# EasyEDA Pro project sle_keyboard.eprj, schematic Schematic1

## Sheets
1 P1: Create Date: 2024-07-11; Page Name: P1; Project Name: sle_keyboard; Schematic Name: Schematic1; Update Date: 2024-08-14; Company: 嘉立创EDA; Page Size: A4; Version: V1.0
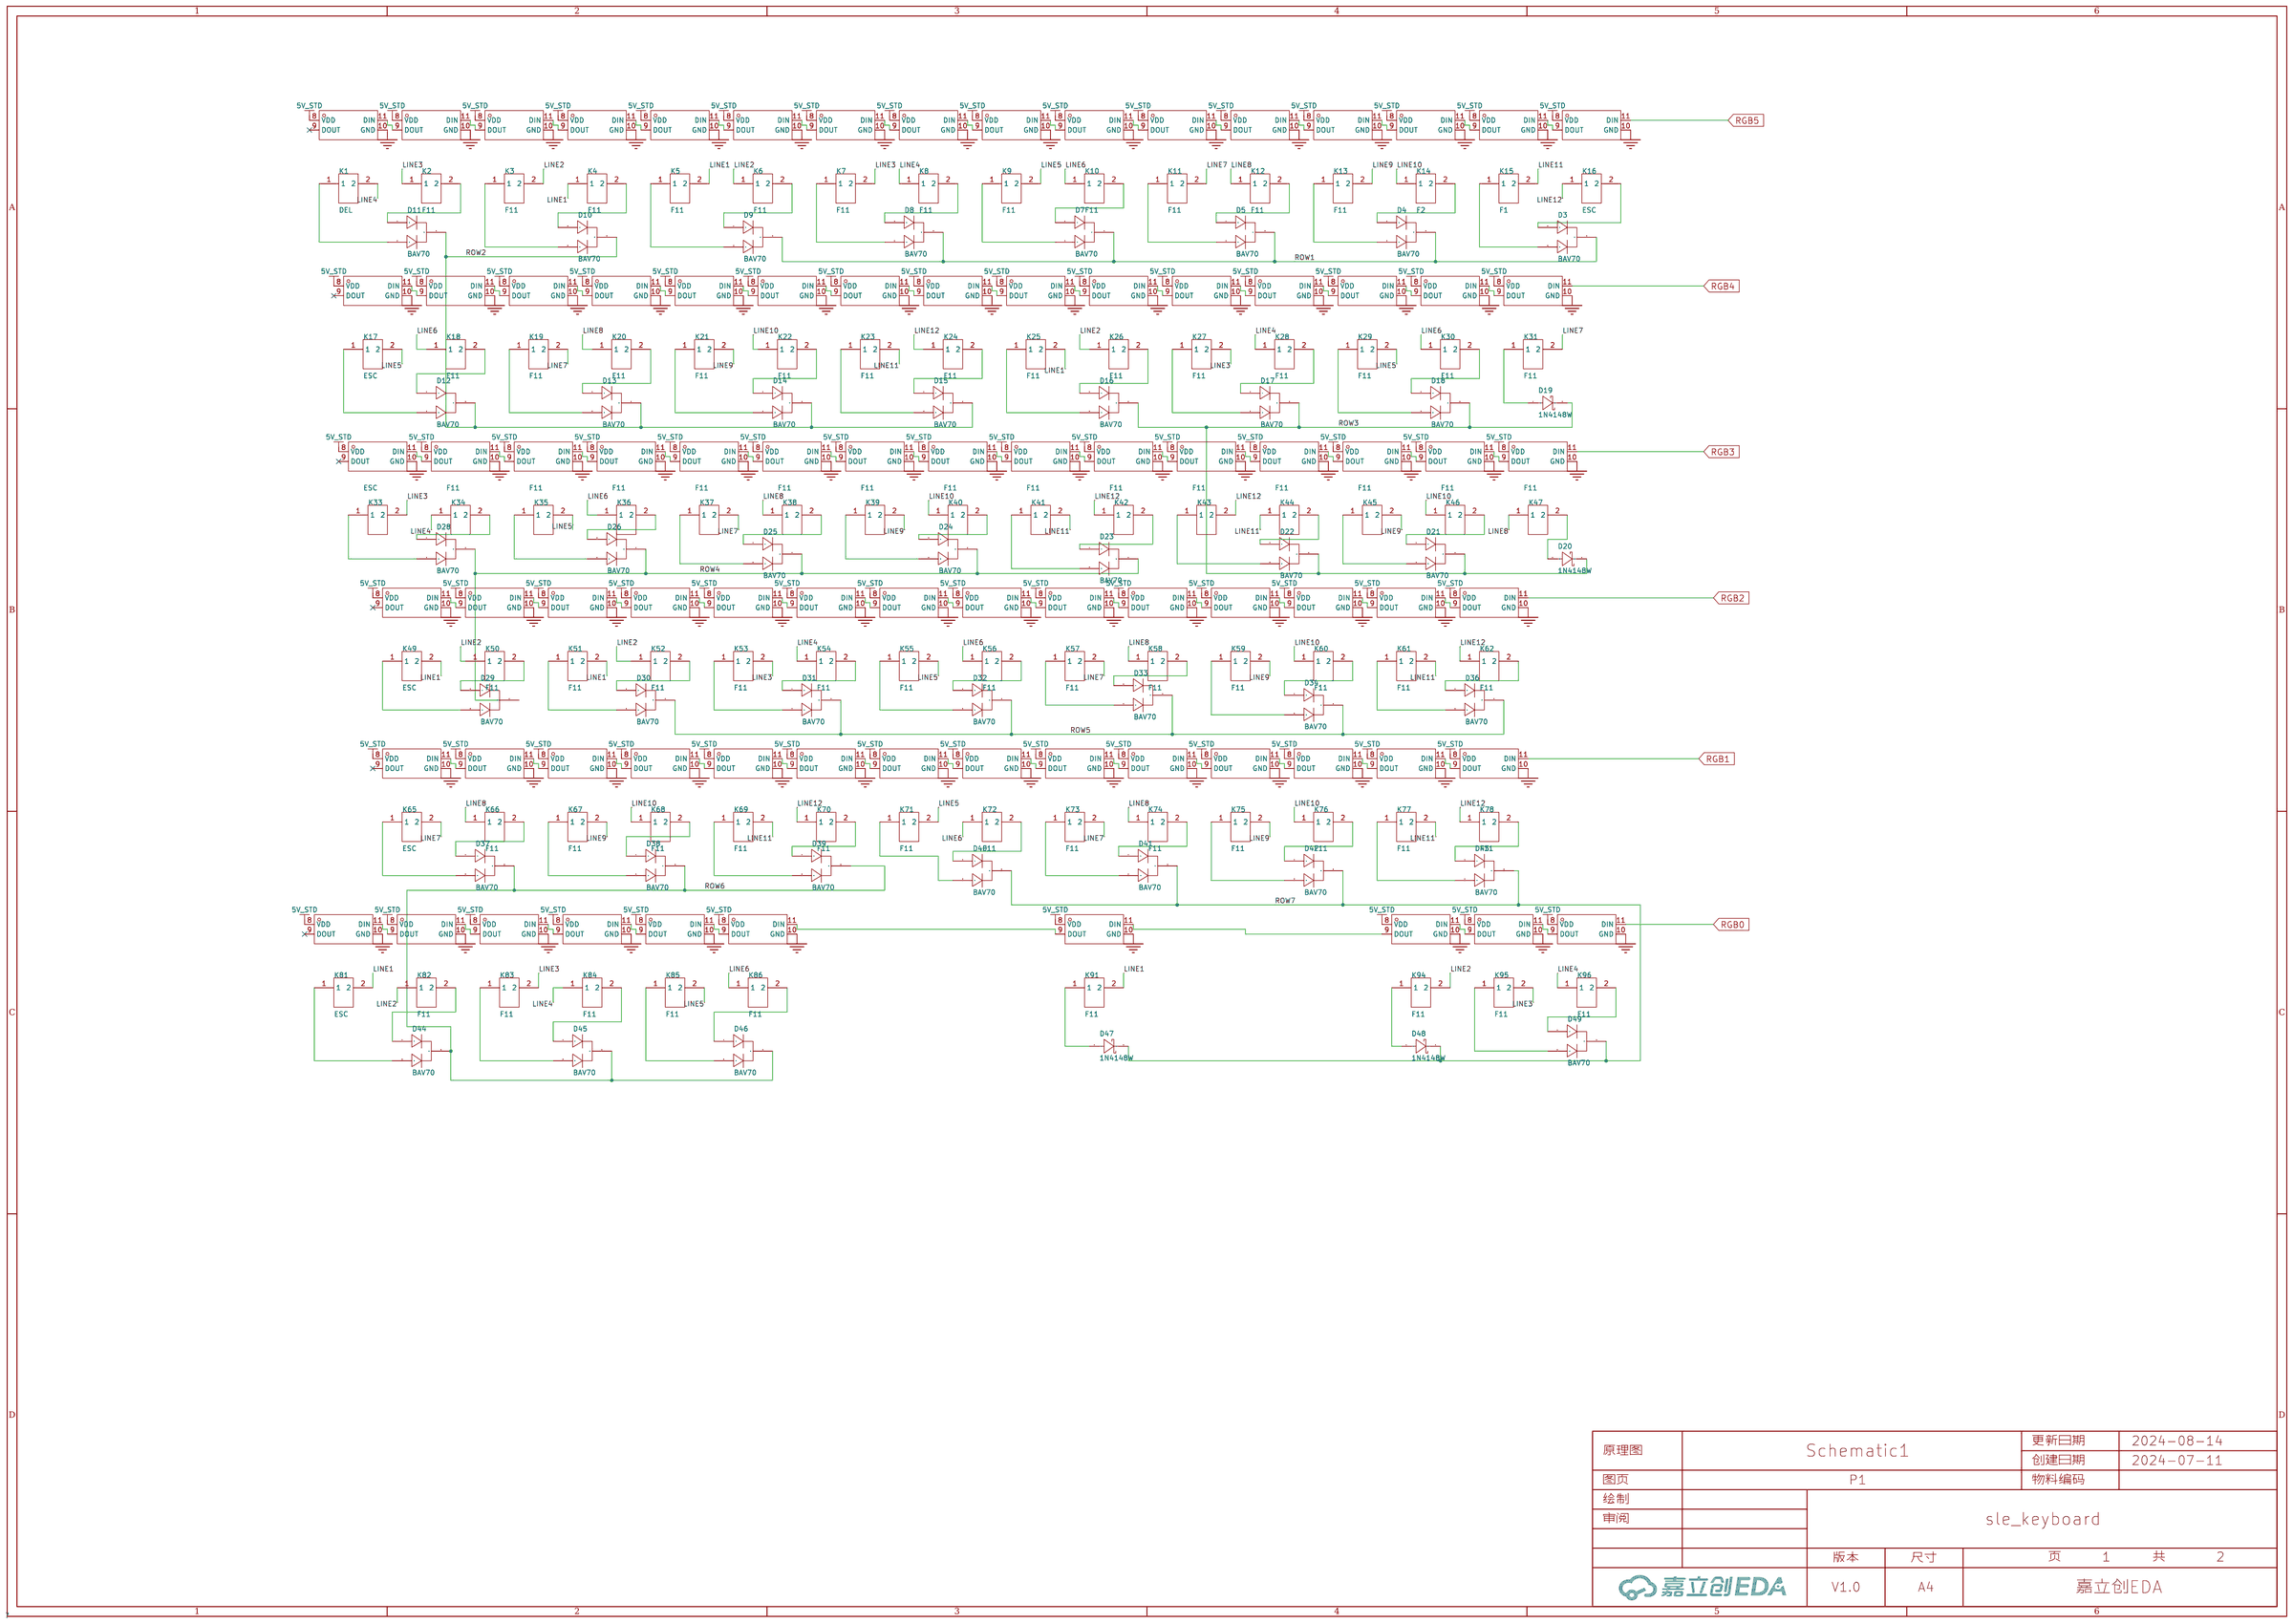
[diagram p0: P1]
2 P2: Board Name: Board1; Create Date: 2024-08-11; Page Name: P2; Update Date: 2024-09-02
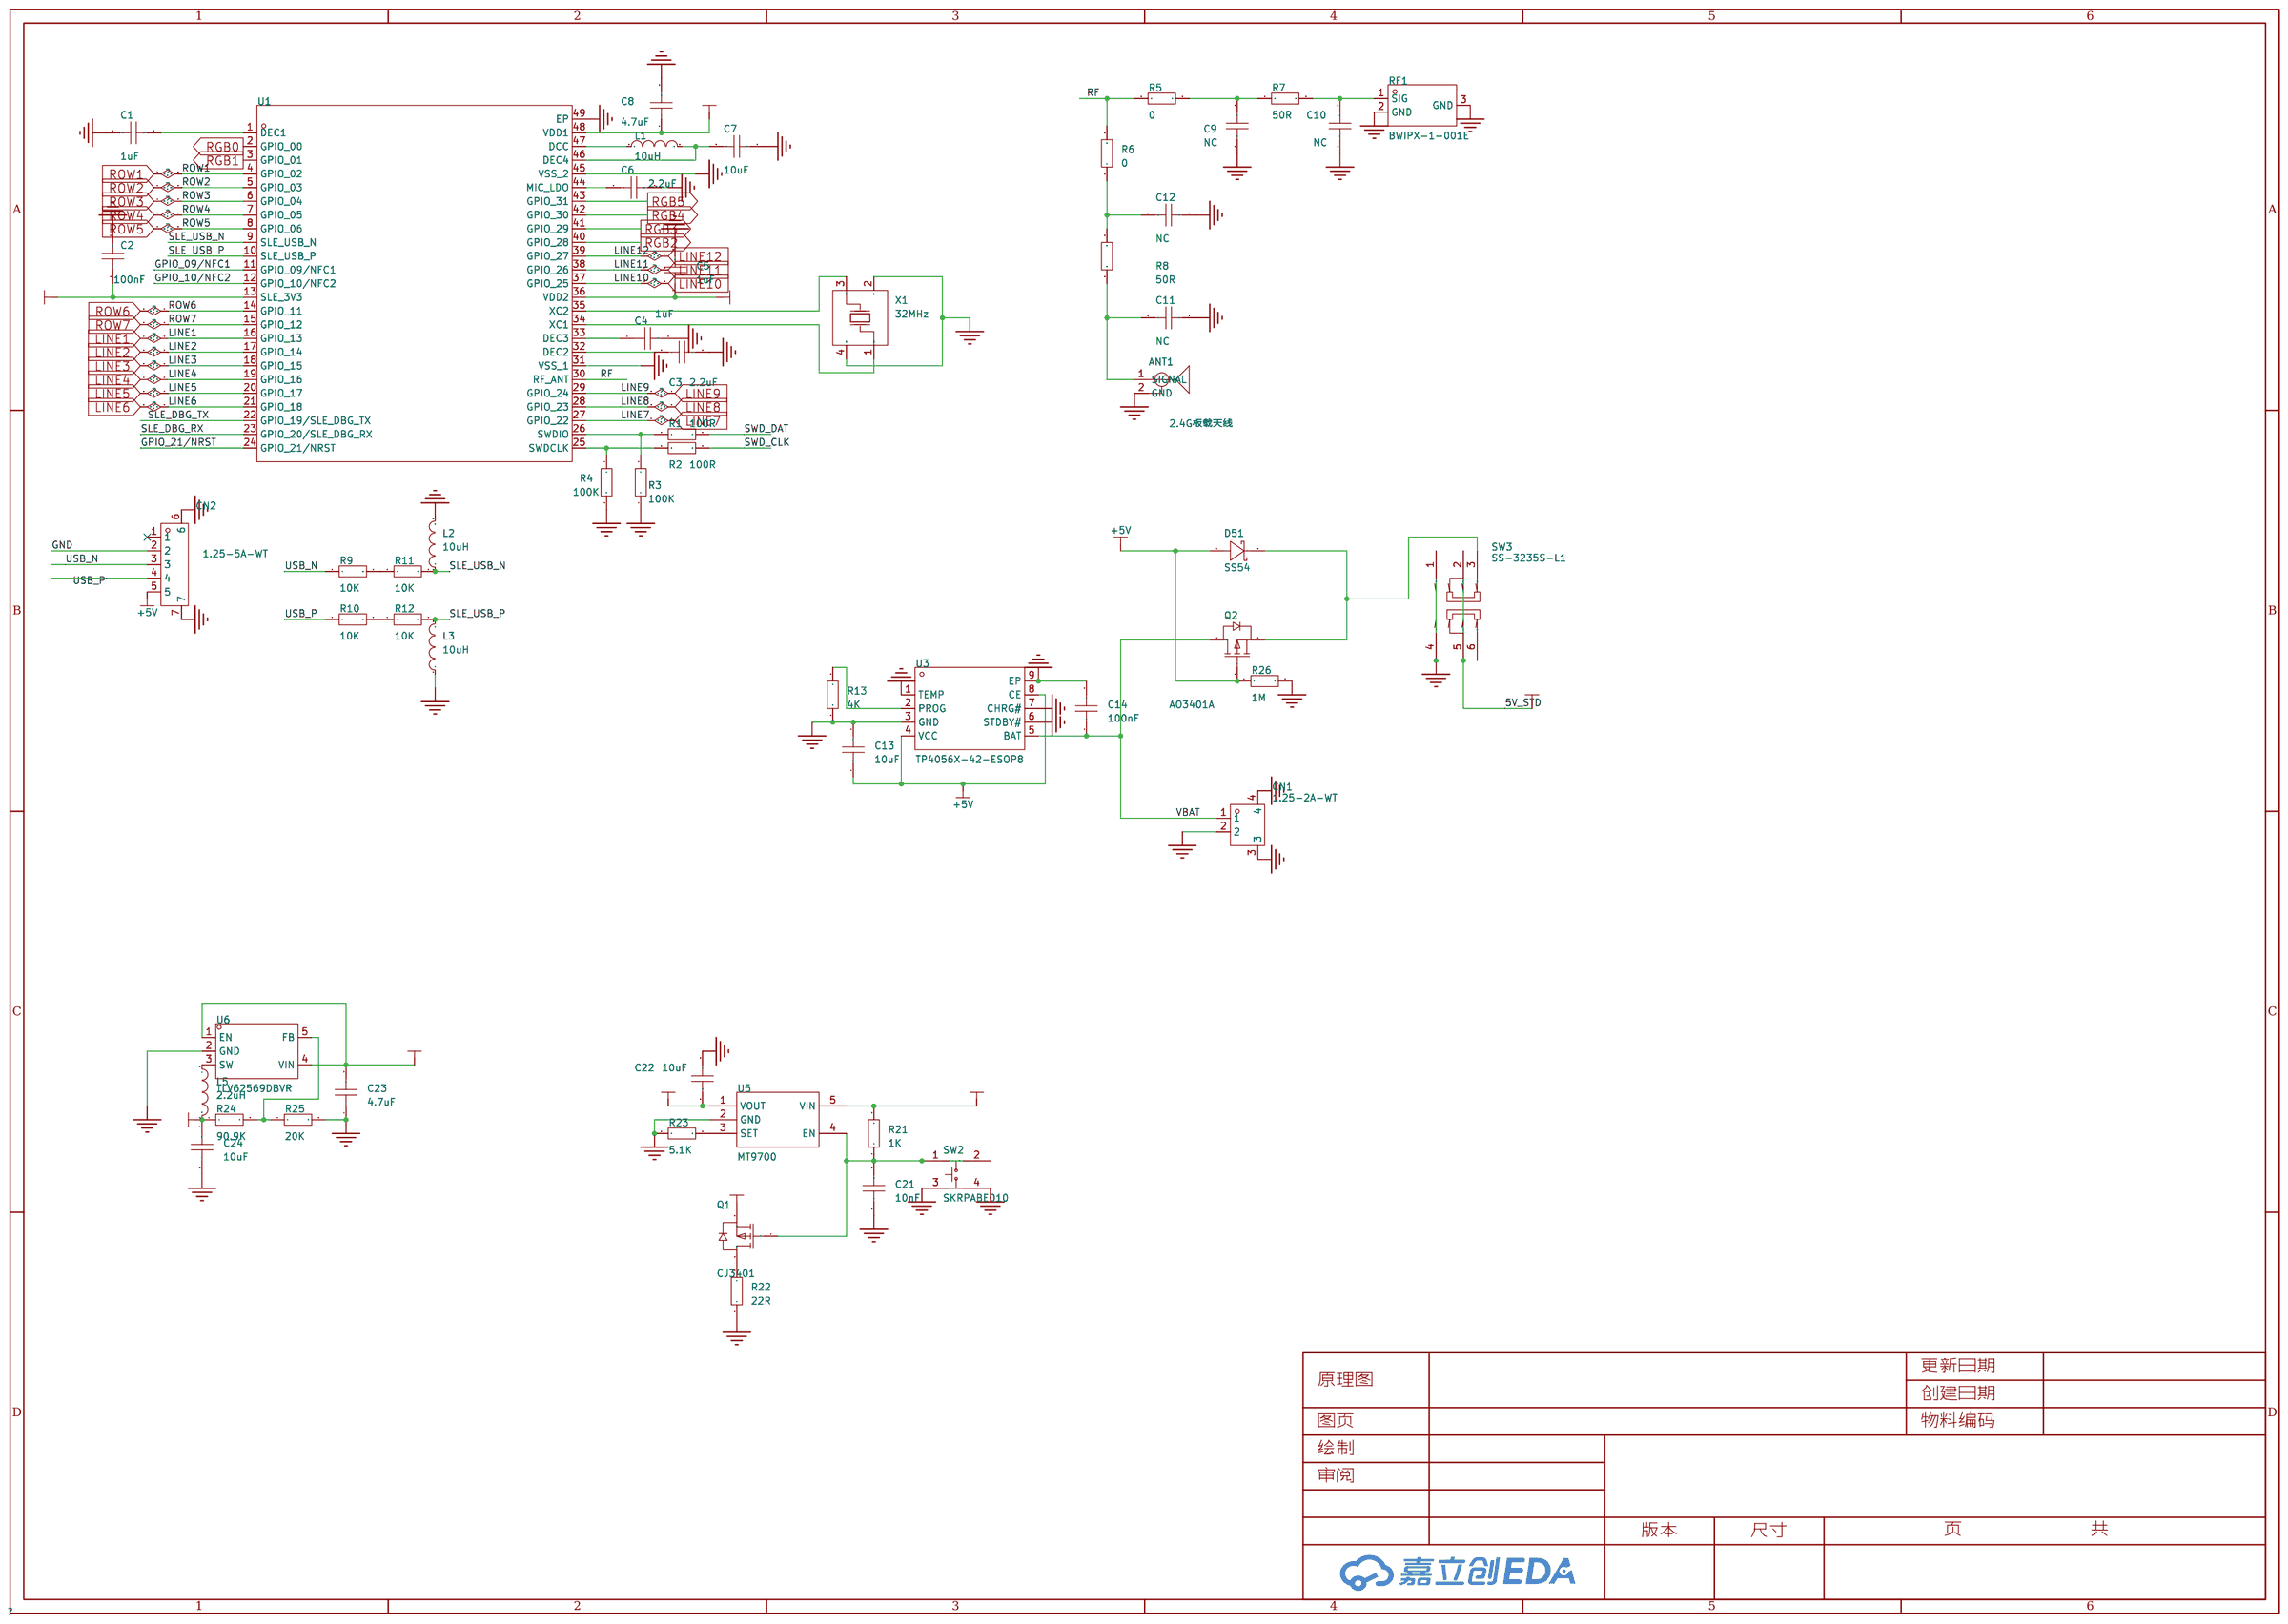
[diagram p1: P2]

## Parts
sheet P1
D3  BAV70  [SOT-23-3_L3.0-W1.7-P0.95-LS2.9-BR]
D4  BAV70  [SOT-23-3_L3.0-W1.7-P0.95-LS2.9-BR]
D5  BAV70  [SOT-23-3_L3.0-W1.7-P0.95-LS2.9-BR]
D7  BAV70  [SOT-23-3_L3.0-W1.7-P0.95-LS2.9-BR]
D8  BAV70  [SOT-23-3_L3.0-W1.7-P0.95-LS2.9-BR]
D9  BAV70  [SOT-23-3_L3.0-W1.7-P0.95-LS2.9-BR]
D10  BAV70  [SOT-23-3_L3.0-W1.7-P0.95-LS2.9-BR]
D11  BAV70  [SOT-23-3_L3.0-W1.7-P0.95-LS2.9-BR]
D12  BAV70  [SOT-23-3_L3.0-W1.7-P0.95-LS2.9-BR]
D13  BAV70  [SOT-23-3_L3.0-W1.7-P0.95-LS2.9-BR]
D14  BAV70  [SOT-23-3_L3.0-W1.7-P0.95-LS2.9-BR]
D15  BAV70  [SOT-23-3_L3.0-W1.7-P0.95-LS2.9-BR]
D16  BAV70  [SOT-23-3_L3.0-W1.7-P0.95-LS2.9-BR]
D17  BAV70  [SOT-23-3_L3.0-W1.7-P0.95-LS2.9-BR]
D18  BAV70  [SOT-23-3_L3.0-W1.7-P0.95-LS2.9-BR]
D19  1N4148W  [SOD-123_L2.7-W1.6-LS3.7-FD]
D20  1N4148W  [SOD-123_L2.7-W1.6-LS3.7-FD]
D21  BAV70  [SOT-23-3_L3.0-W1.7-P0.95-LS2.9-BR]
D22  BAV70  [SOT-23-3_L3.0-W1.7-P0.95-LS2.9-BR]
D23  BAV70  [SOT-23-3_L3.0-W1.7-P0.95-LS2.9-BR]
D24  BAV70  [SOT-23-3_L3.0-W1.7-P0.95-LS2.9-BR]
D25  BAV70  [SOT-23-3_L3.0-W1.7-P0.95-LS2.9-BR]
D26  BAV70  [SOT-23-3_L3.0-W1.7-P0.95-LS2.9-BR]
D28  BAV70  [SOT-23-3_L3.0-W1.7-P0.95-LS2.9-BR]
D29  BAV70  [SOT-23-3_L3.0-W1.7-P0.95-LS2.9-BR]
D30  BAV70  [SOT-23-3_L3.0-W1.7-P0.95-LS2.9-BR]
D31  BAV70  [SOT-23-3_L3.0-W1.7-P0.95-LS2.9-BR]
D32  BAV70  [SOT-23-3_L3.0-W1.7-P0.95-LS2.9-BR]
D33  BAV70  [SOT-23-3_L3.0-W1.7-P0.95-LS2.9-BR]
D34  BAV70  [SOT-23-3_L3.0-W1.7-P0.95-LS2.9-BR]
D36  BAV70  [SOT-23-3_L3.0-W1.7-P0.95-LS2.9-BR]
D37  BAV70  [SOT-23-3_L3.0-W1.7-P0.95-LS2.9-BR]
D38  BAV70  [SOT-23-3_L3.0-W1.7-P0.95-LS2.9-BR]
D39  BAV70  [SOT-23-3_L3.0-W1.7-P0.95-LS2.9-BR]
D40  BAV70  [SOT-23-3_L3.0-W1.7-P0.95-LS2.9-BR]
D41  BAV70  [SOT-23-3_L3.0-W1.7-P0.95-LS2.9-BR]
D42  BAV70  [SOT-23-3_L3.0-W1.7-P0.95-LS2.9-BR]
D43  BAV70  [SOT-23-3_L3.0-W1.7-P0.95-LS2.9-BR]
D44  BAV70  [SOT-23-3_L3.0-W1.7-P0.95-LS2.9-BR]
D45  BAV70  [SOT-23-3_L3.0-W1.7-P0.95-LS2.9-BR]
D46  BAV70  [SOT-23-3_L3.0-W1.7-P0.95-LS2.9-BR]
D47  1N4148W  [SOD-123_L2.7-W1.6-LS3.7-FD]
D48  1N4148W  [SOD-123_L2.7-W1.6-LS3.7-FD]
D49  BAV70  [SOT-23-3_L3.0-W1.7-P0.95-LS2.9-BR]
K1  DEL  [PCBCOMPONENT_2 - DUPLICATE - DUPLICATE]
K2  F11  [PCBCOMPONENT_2 - DUPLICATE - DUPLICATE]
K3  F11  [PCBCOMPONENT_2 - DUPLICATE - DUPLICATE]
K4  F11  [PCBCOMPONENT_2 - DUPLICATE - DUPLICATE]
K5  F11  [PCBCOMPONENT_2 - DUPLICATE - DUPLICATE]
K6  F11  [PCBCOMPONENT_2 - DUPLICATE - DUPLICATE]
K7  F11  [PCBCOMPONENT_2 - DUPLICATE - DUPLICATE]
K8  F11  [PCBCOMPONENT_2 - DUPLICATE - DUPLICATE]
K9  F11  [PCBCOMPONENT_2 - DUPLICATE - DUPLICATE]
K10  F11  [PCBCOMPONENT_2 - DUPLICATE - DUPLICATE]
K11  F11  [PCBCOMPONENT_2 - DUPLICATE - DUPLICATE]
K12  F11  [PCBCOMPONENT_2 - DUPLICATE - DUPLICATE]
K13  F11  [PCBCOMPONENT_2 - DUPLICATE - DUPLICATE]
K14  F2  [PCBCOMPONENT_2 - DUPLICATE - DUPLICATE]
K15  F1  [PCBCOMPONENT_2 - DUPLICATE - DUPLICATE]
K16  ESC  [PCBCOMPONENT_2 - DUPLICATE - DUPLICATE]
K17  ESC  [PCBCOMPONENT_2 - DUPLICATE - DUPLICATE]
K18  F11  [PCBCOMPONENT_2 - DUPLICATE - DUPLICATE]
K19  F11  [PCBCOMPONENT_2 - DUPLICATE - DUPLICATE]
K20  F11  [PCBCOMPONENT_2 - DUPLICATE - DUPLICATE]
K21  F11  [PCBCOMPONENT_2 - DUPLICATE - DUPLICATE]
K22  F11  [PCBCOMPONENT_2 - DUPLICATE - DUPLICATE]
K23  F11  [PCBCOMPONENT_2 - DUPLICATE - DUPLICATE]
K24  F11  [PCBCOMPONENT_2 - DUPLICATE - DUPLICATE]
K25  F11  [PCBCOMPONENT_2 - DUPLICATE - DUPLICATE]
K26  F11  [PCBCOMPONENT_2 - DUPLICATE - DUPLICATE]
K27  F11  [PCBCOMPONENT_2 - DUPLICATE - DUPLICATE]
K28  F11  [PCBCOMPONENT_2 - DUPLICATE - DUPLICATE]
K29  F11  [PCBCOMPONENT_2 - DUPLICATE - DUPLICATE]
K30  F11  [PCBCOMPONENT_2 - DUPLICATE - DUPLICATE]
K31  F11  [PCBCOMPONENT_2 - DUPLICATE - DUPLICATE]
K33  ESC  [PCBCOMPONENT_2 - DUPLICATE - DUPLICATE]
K34  F11  [PCBCOMPONENT_2 - DUPLICATE - DUPLICATE]
K35  F11  [PCBCOMPONENT_2 - DUPLICATE - DUPLICATE]
K36  F11  [PCBCOMPONENT_2 - DUPLICATE - DUPLICATE]
K37  F11  [PCBCOMPONENT_2 - DUPLICATE - DUPLICATE]
K38  F11  [PCBCOMPONENT_2 - DUPLICATE - DUPLICATE]
K39  F11  [PCBCOMPONENT_2 - DUPLICATE - DUPLICATE]
K40  F11  [PCBCOMPONENT_2 - DUPLICATE - DUPLICATE]
K41  F11  [PCBCOMPONENT_2 - DUPLICATE - DUPLICATE]
K42  F11  [PCBCOMPONENT_2 - DUPLICATE - DUPLICATE]
K43  F11  [PCBCOMPONENT_2 - DUPLICATE - DUPLICATE]
K44  F11  [PCBCOMPONENT_2 - DUPLICATE - DUPLICATE]
K45  F11  [PCBCOMPONENT_2 - DUPLICATE - DUPLICATE]
K46  F11  [PCBCOMPONENT_2 - DUPLICATE - DUPLICATE]
K47  F11  [PCBCOMPONENT_2 - DUPLICATE - DUPLICATE]
K49  ESC  [PCBCOMPONENT_2 - DUPLICATE - DUPLICATE]
K50  F11  [PCBCOMPONENT_2 - DUPLICATE - DUPLICATE]
K51  F11  [PCBCOMPONENT_2 - DUPLICATE - DUPLICATE]
K52  F11  [PCBCOMPONENT_2 - DUPLICATE - DUPLICATE]
K53  F11  [PCBCOMPONENT_2 - DUPLICATE - DUPLICATE]
K54  F11  [PCBCOMPONENT_2 - DUPLICATE - DUPLICATE]
K55  F11  [PCBCOMPONENT_2 - DUPLICATE - DUPLICATE]
K56  F11  [PCBCOMPONENT_2 - DUPLICATE - DUPLICATE]
K57  F11  [PCBCOMPONENT_2 - DUPLICATE - DUPLICATE]
K58  F11  [PCBCOMPONENT_2 - DUPLICATE - DUPLICATE]
K59  F11  [PCBCOMPONENT_2 - DUPLICATE - DUPLICATE]
K60  F11  [PCBCOMPONENT_2 - DUPLICATE - DUPLICATE]
K61  F11  [PCBCOMPONENT_2 - DUPLICATE - DUPLICATE]
K62  F11  [PCBCOMPONENT_2 - DUPLICATE - DUPLICATE]
K65  ESC  [PCBCOMPONENT_2 - DUPLICATE - DUPLICATE]
K66  F11  [PCBCOMPONENT_2 - DUPLICATE - DUPLICATE]
K67  F11  [PCBCOMPONENT_2 - DUPLICATE - DUPLICATE]
K68  F11  [PCBCOMPONENT_2 - DUPLICATE - DUPLICATE]
K69  F11  [PCBCOMPONENT_2 - DUPLICATE - DUPLICATE]
K70  F11  [PCBCOMPONENT_2 - DUPLICATE - DUPLICATE]
K71  F11  [PCBCOMPONENT_2 - DUPLICATE - DUPLICATE]
K72  F11  [PCBCOMPONENT_2 - DUPLICATE - DUPLICATE]
K73  F11  [PCBCOMPONENT_2 - DUPLICATE - DUPLICATE]
K74  F11  [PCBCOMPONENT_2 - DUPLICATE - DUPLICATE]
K75  F11  [PCBCOMPONENT_2 - DUPLICATE - DUPLICATE]
K76  F11  [PCBCOMPONENT_2 - DUPLICATE - DUPLICATE]
K77  F11  [PCBCOMPONENT_2 - DUPLICATE - DUPLICATE]
K78  F11  [PCBCOMPONENT_2 - DUPLICATE - DUPLICATE]
K81  ESC  [PCBCOMPONENT_2 - DUPLICATE - DUPLICATE]
K82  F11  [PCBCOMPONENT_2 - DUPLICATE - DUPLICATE]
K83  F11  [PCBCOMPONENT_2 - DUPLICATE - DUPLICATE]
K84  F11  [PCBCOMPONENT_2 - DUPLICATE - DUPLICATE]
K85  F11  [PCBCOMPONENT_2 - DUPLICATE - DUPLICATE]
K86  F11  [PCBCOMPONENT_2 - DUPLICATE - DUPLICATE]
K91  F11  [PCBCOMPONENT_2 - DUPLICATE - DUPLICATE]
K94  F11  [PCBCOMPONENT_2 - DUPLICATE - DUPLICATE]
K95  F11  [PCBCOMPONENT_2 - DUPLICATE - DUPLICATE]
K96  F11  [PCBCOMPONENT_2 - DUPLICATE - DUPLICATE]
sheet P2
ANT1  2.4G板载天线  [ANT-2.4G]
C1  1uF  [C0402]
C2  100nF  [C0402]
C3  2.2uF  [C0402]
C4  1uF  [C0402]
C5  1uF  [C0402]
C6  2.2uF  [C0402]
C7  10uF  [C0603]
C8  4.7uF  [C0402]
C9  NC  [C0201]
C10  NC  [C0201]
C11  NC  [C0201]
C12  NC  [C0201]
C13  10uF  [C0603]
C14  100nF  [C0402]
C21  10nF  [C0402]
C22  10uF  [C0603]
C23  4.7uF  [C0603]
C24  10uF  [C0603]
CN1  1.25-2A-WT  [CONN-TH_1.25-2A-WT]
CN2  1.25-5A-WT  [CONN-SMD_1.25-6A-WT]
D51  SS54  [SMA_L4.3-W2.6-LS5.0-FD]
L1  10uH  [L0805]
L2  10uH  [L0402]
L3  10uH  [L0402]
L5  2.2uH  [IND-SMD_L4.4-W4.2]
Q1  CJ3401  [SOT-23-3_L2.9-W1.6-P1.90-LS2.8-BR]
Q2  AO3401A  [SOT-23_L2.9-W1.3-P1.90-LS2.4-BR]
R1  100R  [R0402]
R2  100R  [R0402]
R3  100K  [R0402]
R4  100K  [R0402]
R5  0  [R0201]
R6  0  [R0201]
R7  50R  [R0201]
R8  50R  [R0201]
R9  10K  [R0402]
R10  10K  [R0402]
R11  10K  [R0402]
R12  10K  [R0402]
R13  4K  [R0402]
R21  1K  [R0402]
R22  22R  [R0805]
R23  5.1K  [R0402]
R24  90.9K  [R0402]
R25  20K  [R0402]
R26  1M  [R0402]
RF1  BWIPX-1-001E  [IPEX-SMD_BWIPX-1-001E]
SW2  SKRPABE010  [KEY-SMD_4P-L4.2-W3.2-P2.20-LS4.6]
SW3  SS-3235S-L1  [SW-SMD_SS-3235S-LX]
U1  -  [QFN-48_L6.0-W6.0-P0.40-TL-EP4.4]
U3  TP4056X-42-ESOP8  [SOP-8_L4.9-W3.9-P1.27-LS6.0-TL-EP]
U5  MT9700  [SOT-23-5_L3.0-W1.7-P0.95-LS2.8-BR]
U6  TLV62569DBVR  [SOT-23-5_L3.0-W1.7-P0.95-LS2.8-BR]
X1  32MHz  [OSC-SMD_4P-L2.0-W1.6-BL]

## Library data of the parts
D3-D5 D7-D18 D21-D26 D28-D34 D36-D46 D49 = BAV70_C68978: 二极管配置:1对共阴极;正向压降(Vf):1.25V@150mA;直流反向耐压(Vr):70V;平均整流电流(Io):200mA;功率:225mW;反向恢复时间(trr):6ns;; LCSC Part Name: 电压:70V 电流:200mA; Supplier Part: C68978; Manufacturer: CJ(江苏长电/长晶); Supplier Footprint: SOT-23; JLCPCB Part Class: 基础库; Datasheet: https://atta.szlcsc.com/upload/public/pdf/source/20160516/1463363920256.pdf; Supplier: LCSC; Diode Configuration: 1对共阴极; Forward Voltage (Vf@If): 1.25V@150mA; Reverse Voltage (Vr): 70V; Average Rectified Current (Io): 200mA; Power Dissipation: 225mW; Reverse Leakage Current: 2.5uA@70V; Reverse Recovery Time (trr): 6ns
D19 D20 D47 D48 = 1N4148W_C7420318: 二极管配置:独立式;正向压降(Vf):1.25V@150mA;直流反向耐压(Vr):100V;平均整流电流(Io):150mA;功率:400mW;反向恢复时间(trr):4ns;; LCSC Part Name: 电压:100V 电流:150mA; Supplier Part: C7420318; Manufacturer: 宏迦橙; Supplier Footprint: SOD-123; JLCPCB Part Class: 扩展库; Datasheet: https://atta.szlcsc.com/upload/public/pdf/source/20230828/E5C3F7A4272052930A7E03B75759BF50.pdf; Supplier: LCSC; Diode Configuration: 独立式; Forward Voltage (Vf@If): 1.25V@150mA; Reverse Voltage (Vr): 100V; Average Rectified Current (Io): 150mA; Power Dissipation: 400mW; Reverse Leakage Current: 1uA@75V; Reverse Recovery Time (trr): 4ns; Operating Temperature: -55℃~+150℃
K1-K31 K33-K47 K49-K62 K65-K78 K81-K86 K91 K94-K96 = 轴座封装
ANT1 = 2.4G板载天线
C1-C6 C8-C14 C21 C23 C24 = CAP_0402: Supplier Footprint: 0402
C7 C22 = CAP_0603: Supplier Footprint: 0603
CN1 = 1.25-2A-WT: 插针结构:1x2P;间距:1.25mm;安装方式:卧贴;参考系列:-;总PIN数:2P;排数:1;每排PIN数:2;行距:-;额定电流:500mA;工作温度范围:-25℃~+85℃;; LCSC Part Name: 1x2P 间距:1.25mm 卧贴; Supplier Part: C722596; Manufacturer: CAX(创都); Supplier Footprint: SMD,P=1.25mm,卧贴; JLCPCB Part Class: 扩展库; Datasheet: https://atta.szlcsc.com/upload/public/pdf/source/20200831/C722596_8E06BADB8DB7299BF643CBA8EAB94548.pdf; Supplier: LCSC; Pins Structure: 1x2P; Pitch: 1.25mm; Mounting Style: 卧贴; Number of Pins: 2P; Number of Rows: 1; Number of PINs Per Row: 2; Current Rating (Max): 500mA; Operating Temperature Range: -25℃~+85℃
CN2 = 1.25-5A-WT: 插针结构:1x5P;间距:1.25mm;安装方式:卧贴;参考系列:-;总PIN数:5P;排数:1;每排PIN数:5;行距:-;额定电流:500mA;工作温度范围:-25℃~+85℃;; LCSC Part Name: 1x5P 间距:1.25mm 卧贴; Supplier Part: C722605; Manufacturer: CAX(创都); Supplier Footprint: SMD,P=1.25mm,卧贴; JLCPCB Part Class: 扩展库; Datasheet: https://atta.szlcsc.com/upload/public/pdf/source/20200831/C722596_8E06BADB8DB7299BF643CBA8EAB94548.pdf; Supplier: LCSC; Pins Structure: 1x5P; Pitch: 1.25mm; Mounting Style: 卧贴; Number of Pins: 5P; Number of Rows: 1; Number of PINs Per Row: 5; Current Rating (Max): 500mA; Operating Temperature Range: -25℃~+85℃
D51 = SS54_C7420369: 二极管配置:独立式;正向压降(Vf):550mV@5.0A;直流反向耐压(Vr):40V;整流电流:5A;; LCSC Part Name: 电压:40V 电流:5A; Supplier Part: C7420369; Manufacturer: 宏迦橙; Supplier Footprint: SMA(DO-214AC); JLCPCB Part Class: 扩展库; Datasheet: https://atta.szlcsc.com/upload/public/pdf/source/20230828/254C3882F8647358AD9F60DD73611B5E.pdf; Supplier: LCSC; Diode Configuration: 独立式; Forward Voltage (Vf@If): 550mV@5.0A; Reverse Voltage (Vr): 40V; Rectified Current: 5A; Reverse Leakage Current (Ir): 50uA@40V
L1 = L_0805
L2 L3 = L_0603: Supplier Footprint: L0603
L5 = FXL0420-2R2-M: 电感值:2.2uH;精度:±20%;额定电流:4.5A;饱和电流(Isat):5A;类型:一体成型电感;; LCSC Part Name: 2.2uH ±20% 5A; Supplier Part: C167206; Manufacturer: cjiang(长江微电); Supplier Footprint: SMD,4.2x4.4mm; JLCPCB Part Class: 扩展库; Datasheet: https://atta.szlcsc.com/upload/public/pdf/source/20240426/3189EA8206330E2108542F9E34E540E7.pdf; Supplier: LCSC; Tolerance: ±20%; Rated Current: 4.5A; Saturation Current (Isat): 5A; DC Resistance (DCR): 58mΩ; Type: 一体成型电感
Q1 = CJ3401: 类型:1个P沟道;漏源电压(Vdss):30V;连续漏极电流(Id):4.2A;功率(Pd):350mW;导通电阻(RDS(on)@Vgs,Id):65mΩ@10V,4.2A;阈值电压(Vgs(th)@Id):1.3V@250uA;; LCSC Part Name: 1个P沟道 耐压:30V 电流:4.2A; Supplier Part: C13799; Manufacturer: CJ(江苏长电/长晶); Supplier Footprint: SOT-23; JLCPCB Part Class: 扩展库; Datasheet: https://atta.szlcsc.com/upload/public/pdf/source/20140815/1457707217656.pdf; Supplier: LCSC; Type: 1个P沟道; Drain Source Voltage (Vdss): 30V; Continuous Drain Current (Id): 4.2A; Power Dissipation (Pd): 350mW; Drain Source On Resistance (RDS(on)@Vgs,Id): 65mΩ@10V,4.2A; Gate Threshold Voltage (Vgs(th)@Id): 1.3V@250uA
Q2 = AO3401A_C15127: LCSC Part Name: 1个P沟道 耐压:30V 电流:4A; Supplier Part: C15127; Manufacturer: AOS; Supplier Footprint: SOT-23; JLCPCB Part Class: 基础库; Datasheet: https://atta.szlcsc.com/upload/public/pdf/source/20160507/1462613609053.pdf; Supplier: LCSC; Type: 1个P沟道; Drain Source Voltage (Vdss): 30V; Continuous Drain Current (Id): 4A; Drain Source On Resistance (RDS(on)@Vgs,Id): 44mΩ@10V,4.3A; Power Dissipation (Pd): 1.4W; Gate Threshold Voltage (Vgs(th)@Id): 1.3V@250uA; Total Gate Charge (Qg@Vgs): 12.2nC@4.5V; Input Capacitance (Ciss@Vds): 1.2nF@15V; Operating Temperature: -55℃~+150℃@(Tj)
R1-R4 R13 R21 R23-R26 = Res_0402: Supplier Footprint: 0402
R5-R8 = Res_0201: Supplier Footprint: 0201
R9-R12 = Res_0603: Supplier Footprint: 0603
R22 = Res_0805: Supplier Footprint: 0805
RF1 = BWIPX-1-001E: 连接器类型:板端;接口类型:内针;端口数量:1;接口直径:-;接口长度/高度:-;频率-最大值:6GHz;射频系列:IPEX;阻抗:50Ω;样式:-;工作温度范围:-;; LCSC Part Name: IPEX 内针; Supplier Part: C496552; Manufacturer: BAT WIRELESS(蝙蝠无线); Supplier Footprint: SMD; JLCPCB Part Class: Extended Part; Datasheet: https://atta.szlcsc.com/upload/public/pdf/source/20201223/C496552_05E5A9956EAE1A8819C5051D085B1DED.pdf; Supplier: LCSC; Connector Type: 板端; Interface Type: 内针; Number of Ports: 1; Frequency-Max: 6GHz; RF Series: IPEX; Impedance: 50Ω
SW2 = SKRPABE010: 电路结构:单刀单掷;按钮形状:椭圆形按钮;安装方式:立贴;开关长度:4.2mm;开关宽度:3.2mm;开关高度:2.5mm;触点电流:50mA;额定电压(DC):16V;带灯:-;机械寿命:-;; LCSC Part Name: 4.2*3.2*2.5mm 立贴 轻触开关; Supplier Part: C115360; Manufacturer: ALPSALPINE(阿尔卑斯阿尔派); Supplier Footprint: SMD; JLCPCB Part Class: 扩展库; Datasheet: https://atta.szlcsc.com/upload/public/pdf/source/20230112/DF75D5D18E1B5268218CBB1743AEACBB.pdf; Supplier: LCSC; Circuit: 单刀单掷; Actuator Style: 椭圆形按钮; Mounting Style: 立贴; Switch Length: 4.2mm; Switch Width: 3.2mm; Switch Height: 2.5mm; Contact Current: 50mA; Voltage Rating (DC): 16V
SW3 = SS-3235S-L1: 电路结构:双刀双掷;安装方式:卧贴;开关颜色:黑色;额定电流(DC):50mA;额定电压(DC):12V;额定电流(AC):50mA;额定电压(AC):12V;机械寿命:1万次;; LCSC Part Name: 柄长2mm 卧贴双档 滑动开关; Supplier Part: C500055; Manufacturer: XKB Connectivity(中国星坤); Supplier Footprint: SMD; JLCPCB Part Class: 扩展库; Datasheet: https://atta.szlcsc.com/upload/public/pdf/source/20211011/39D516E750C13BE9339464E723D9F132.pdf; Supplier: LCSC; Circuit: 双刀双掷; Actuator Style: 矩形柱状; Pin Style: 鸥翼型; Switch Length: 9.1mm; Switch Width: 3.55mm; Switch Height: 3.2mm; Mounting Style: 卧贴; Actuator Color: 黑色; Current Rating (DC): 50mA; Voltage Rating (DC): 12V; Current Rating (AC): 50mA; Voltage Rating (AC): 12V; Mechanical Life: 1万次; Operating Temperature: -40℃~+85℃
U1 = hi2821: Manufacturer: 海思; Supplier Footprint: QFN-48; JLCPCB Part Class: 扩展库
U3 = TP4056X-42-ESOP8: Supplier Part: C2763448; Manufacturer: TOPPOWER(南京拓微); Supplier Footprint: SOP-8-EP; JLCPCB Part Class: 扩展库; Datasheet: https://atta.szlcsc.com/upload/public/pdf/source/20221111/3D7D53D5011BF4ED4C4D0D9BFDBB1404.pdf; Supplier: LCSC
U5 = MT9700: 低功耗负载开关/USB电源开关/限流保护开关; Supplier Part: C89855; Manufacturer: 西安航天民芯; Supplier Footprint: SOT-23-5; JLCPCB Part Class: 扩展库; Datasheet: https://atta.szlcsc.com/upload/public/pdf/source/20170418/1492481333031.pdf; Supplier: LCSC
U6 = TLV62569DBVR: 功能类型:降压型;输出类型:可调;输入电压:2.5V~5.5V;输出电压:600mV~5.5V;输出电流(最大值):2A;; Supplier Part: C141836; Manufacturer: TI(德州仪器); Supplier Footprint: SOT-23-5; JLCPCB Part Class: 扩展库; Datasheet: https://www.ti.com/cn/lit/gpn/tlv62569; Supplier: LCSC; Function: 降压型; Output Type: 可调; Input Voltage: 2.5V~5.5V; Output Voltage: 600mV~5.5V; Output Current (Max): 2A; Switching Frequency: 1.5MHz; Operating Temperature: -40℃~+125℃@(TJ); Synchronous Rectification: 是; Topology: 降压式; Switch tube (built-in/external): 内置
X1 = X201632MKD4SI: 晶振类型:贴片晶振;频率:32MHz;常温频差:±20ppm;外接负载电容:8pF;频率稳定度(全温):±20ppm;; LCSC Part Name: 32MHz ±20ppm 8pF 停产; Supplier Part: C108165; Manufacturer: YXC(扬兴晶振); Supplier Footprint: SMD2016-4P; JLCPCB Part Class: 扩展库; Datasheet: https://atta.szlcsc.com/upload/public/pdf/source/20210329/C108154_97241DDF47B5B71D7D93F8906D63DA2F.pdf; Supplier: LCSC; Crystal Type: 贴片晶振; Normal temperature Frequency Tolerance: ±20ppm; External load capacitor: 8pF; Frequency Stability(Full temperature range): ±20ppm; Operating Temperature: -40℃~+85℃

## Nets
5V_STD: C23.2 K1.8(VDD) K2.8(VDD) K3.8(VDD) K4.8(VDD) K5.8(VDD) K6.8(VDD) K7.8(VDD) K8.8(VDD) K9.8(VDD) K10.8(VDD) K11.8(VDD) K12.8(VDD) K13.8(VDD) K14.8(VDD) K15.8(VDD) K16.8(VDD) K17.8(VDD) K18.8(VDD) K19.8(VDD) K20.8(VDD) K21.8(VDD) K22.8(VDD) K23.8(VDD) K24.8(VDD) K25.8(VDD) K26.8(VDD) K27.8(VDD) K28.8(VDD) K29.8(VDD) K30.8(VDD) K31.8(VDD) K33.8(VDD) K34.8(VDD) K35.8(VDD) K36.8(VDD) K37.8(VDD) K38.8(VDD) K39.8(VDD) K40.8(VDD) K41.8(VDD) K42.8(VDD) K43.8(VDD) K44.8(VDD) K45.8(VDD) K46.8(VDD) K47.8(VDD) K49.8(VDD) K50.8(VDD) K51.8(VDD) K52.8(VDD) K53.8(VDD) K54.8(VDD) K55.8(VDD) K56.8(VDD) K57.8(VDD) K58.8(VDD) K59.8(VDD) K60.8(VDD) K61.8(VDD) K62.8(VDD) K65.8(VDD) K66.8(VDD) K67.8(VDD) K68.8(VDD) K69.8(VDD) K70.8(VDD) K71.8(VDD) K72.8(VDD) K73.8(VDD) K74.8(VDD) K75.8(VDD) K76.8(VDD) K77.8(VDD) K78.8(VDD) K81.8(VDD) K82.8(VDD) K83.8(VDD) K84.8(VDD) K85.8(VDD) K86.8(VDD) K91.8(VDD) K94.8(VDD) K95.8(VDD) K96.8(VDD) SW3.2 SW3.5 U6.1(EN) U6.4(VIN)
+5V: C13.1 CN2.5 D51.1(A) Q2.1(G) R26.1 U3.4(VCC) U3.8(CE)
GND: ANT1.2(GND) C1.1 C2.2 C3.2 C4.2 C5.2 C6.2 C7.2 C8.2 C9.1 C10.1 C11.1 C12.1 C13.2 C14.2 C21.1 C22.2 C23.1 C24.1 CN1.2 CN1.3 CN1.4 CN2.2 CN2.6 CN2.7 K1.10(GND) K2.10(GND) K3.10(GND) K4.10(GND) K5.10(GND) K6.10(GND) K7.10(GND) K8.10(GND) K9.10(GND) K10.10(GND) K11.10(GND) K12.10(GND) K13.10(GND) K14.10(GND) K15.10(GND) K16.10(GND) K17.10(GND) K18.10(GND) K19.10(GND) K20.10(GND) K21.10(GND) K22.10(GND) K23.10(GND) K24.10(GND) K25.10(GND) K26.10(GND) K27.10(GND) K28.10(GND) K29.10(GND) K30.10(GND) K31.10(GND) K33.10(GND) K34.10(GND) K35.10(GND) K36.10(GND) K37.10(GND) K38.10(GND) K39.10(GND) K40.10(GND) K41.10(GND) K42.10(GND) K43.10(GND) K44.10(GND) K45.10(GND) K46.10(GND) K47.10(GND) K49.10(GND) K50.10(GND) K51.10(GND) K52.10(GND) K53.10(GND) K54.10(GND) K55.10(GND) K56.10(GND) K57.10(GND) K58.10(GND) K59.10(GND) K60.10(GND) K61.10(GND) K62.10(GND) K65.10(GND) K66.10(GND) K67.10(GND) K68.10(GND) K69.10(GND) K70.10(GND) K71.10(GND) K72.10(GND) K73.10(GND) K74.10(GND) K75.10(GND) K76.10(GND) K77.10(GND) K78.10(GND) K81.10(GND) K82.10(GND) K83.10(GND) K84.10(GND) K85.10(GND) K86.10(GND) K91.10(GND) K94.10(GND) K95.10(GND) K96.10(GND) L2.2 L3.1 R3.1 R4.2 R13.1 R22.1 R23.1 R25.2 R26.2 RF1.2(GND) RF1.3(GND) SW2.3 SW2.4 SW3.1 SW3.4 U1.31(VSS_1) U1.45(VSS_2) U1.49(EP) U3.1(TEMP) U3.3(GND) U3.6(STDBY#) U3.7(CHRG#) U3.9(EP) U5.2(GND) U6.2(GND) X1.2(GND) X1.4(GND)
VBAT: C14.1 CN1.1 Q2.3(D) U3.5(BAT)
GPIO_09/NFC1: U1.11(GPIO_09/NFC1)
GPIO_10/NFC2: U1.12(GPIO_10/NFC2)
GPIO_21/NRST: U1.24(GPIO_21/NRST)
LINE1: K4.1 K5.2 K25.2 K49.2 K51.2 K81.2 K91.2 U1.16(GPIO_13)
LINE2: K3.2 K6.1 K26.1 K50.1 K52.1 K82.1 K94.2 U1.17(GPIO_14)
LINE3: K2.1 K7.2 K27.2 K33.2 K53.2 K83.2 K95.2 U1.18(GPIO_15)
LINE4: K1.2 K8.1 K28.1 K34.1 K54.1 K84.1 K96.1 U1.19(GPIO_16)
LINE5: K9.2 K17.2 K29.2 K35.2 K55.2 K71.2 K85.2 U1.20(GPIO_17)
LINE6: K10.1 K18.1 K30.1 K36.1 K56.1 K72.1 K86.1 U1.21(GPIO_18)
LINE7: K11.2 K19.2 K31.2 K37.2 K57.2 K65.2 K73.2 U1.27(GPIO_22)
LINE8: K12.1 K20.1 K38.1 K47.1 K58.1 K66.1 K74.1 U1.28(GPIO_23)
LINE9: K13.2 K21.2 K39.2 K45.2 K59.2 K67.2 K75.2 U1.29(GPIO_24)
LINE10: K14.1 K22.1 K40.1 K46.1 K60.1 K68.1 K76.1 U1.37(GPIO_25)
LINE11: K15.2 K23.2 K41.2 K44.1 K61.2 K69.2 K77.2 U1.38(GPIO_26)
LINE12: K16.1 K24.1 K42.1 K43.2 K62.1 K70.1 K78.1 U1.39(GPIO_27)
RF: R5.1 R6.2 U1.30(RF_ANT)
RGB0: K96.11(DIN) U1.2(GPIO_00)
RGB1: K78.11(DIN) U1.3(GPIO_01)
RGB2: K62.11(DIN) U1.40(GPIO_28)
RGB3: K47.11(DIN) U1.41(GPIO_29)
RGB4: K31.11(DIN) U1.42(GPIO_30)
RGB5: K16.11(DIN) U1.43(GPIO_31)
ROW1: D3.3 D4.3 D5.3 D7.3 D8.3 D9.3 U1.4(GPIO_02)
ROW2: D10.3 D11.3 D12.3 D13.3 D14.3 D15.3 U1.5(GPIO_03)
ROW3: D16.3 D17.3 D18.3 D19.2(K) D20.2(K) D21.3 D22.3 U1.6(GPIO_04)
ROW4: D23.3 D24.3 D25.3 D26.3 D28.3 D29.3 U1.7(GPIO_05)
ROW5: D30.3 D31.3 D32.3 D33.3 D34.3 D36.3 U1.8(GPIO_06)
ROW6: D37.3 D38.3 D39.3 D44.3 D45.3 D46.3 U1.14(GPIO_11)
ROW7: D40.3 D41.3 D42.3 D43.3 D47.2(K) D48.2(K) D49.3 U1.15(GPIO_12)
SLE_3V3: C2.1 C5.1 C8.1 C22.1 Q1.2(S) U1.13(SLE_3V3) U1.36(VDD2) U1.48(VDD1) U5.1(VOUT)
SLE_DBG_RX: U1.23(GPIO_20/SLE_DBG_RX)
SLE_DBG_TX: U1.22(GPIO_19/SLE_DBG_TX)
SLE_USB_N: L2.1 R11.2 U1.9(SLE_USB_N)
SLE_USB_P: L3.2 R12.2 U1.10(SLE_USB_P)
SWD_CLK: R2.2
SWD_DAT: R1.2
SYS_3V3: C24.2 L5.2 R21.2 R24.1 U5.5(VIN)
USB_N: CN2.3 R9.1
USB_P: CN2.4 R10.1
$1N13661: K13.11(DIN) K14.9(DOUT)
$1N13668: K14.11(DIN) K15.9(DOUT)
$1N13672: K15.11(DIN) K16.9(DOUT)
$1N13676: K12.11(DIN) K13.9(DOUT)
$1N13680: K11.11(DIN) K12.9(DOUT)
$1N13684: K10.11(DIN) K11.9(DOUT)
$1N13688: K9.11(DIN) K10.9(DOUT)
$1N13692: K8.11(DIN) K9.9(DOUT)
$1N13696: K7.11(DIN) K8.9(DOUT)
$1N13700: K6.11(DIN) K7.9(DOUT)
$1N13704: K5.11(DIN) K6.9(DOUT)
$1N13708: K4.11(DIN) K5.9(DOUT)
$1N13712: K3.11(DIN) K4.9(DOUT)
$1N13716: K2.11(DIN) K3.9(DOUT)
$1N13720: K1.11(DIN) K2.9(DOUT)
$1N13724: K17.11(DIN) K18.9(DOUT)
$1N13728: K18.11(DIN) K19.9(DOUT)
$1N13732: K19.11(DIN) K20.9(DOUT)
$1N13736: K20.11(DIN) K21.9(DOUT)
$1N13740: K21.11(DIN) K22.9(DOUT)
$1N13744: K22.11(DIN) K23.9(DOUT)
$1N13748: K23.11(DIN) K24.9(DOUT)
$1N13752: K24.11(DIN) K25.9(DOUT)
$1N13756: K25.11(DIN) K26.9(DOUT)
$1N13760: K26.11(DIN) K27.9(DOUT)
$1N13764: K27.11(DIN) K28.9(DOUT)
$1N13768: K28.11(DIN) K29.9(DOUT)
$1N13772: K29.11(DIN) K30.9(DOUT)
$1N13776: K30.11(DIN) K31.9(DOUT)
$1N13780: K33.11(DIN) K34.9(DOUT)
$1N13784: K34.11(DIN) K35.9(DOUT)
$1N13788: K35.11(DIN) K36.9(DOUT)
$1N13792: K36.11(DIN) K37.9(DOUT)
$1N13796: K37.11(DIN) K38.9(DOUT)
$1N13800: K38.11(DIN) K39.9(DOUT)
$1N13804: K39.11(DIN) K40.9(DOUT)
$1N13808: K40.11(DIN) K41.9(DOUT)
$1N13812: K41.11(DIN) K42.9(DOUT)
$1N13816: K42.11(DIN) K43.9(DOUT)
$1N13820: K43.11(DIN) K44.9(DOUT)
$1N13824: K44.11(DIN) K45.9(DOUT)
$1N13828: K45.11(DIN) K46.9(DOUT)
$1N13832: K46.11(DIN) K47.9(DOUT)
$1N13836: K49.11(DIN) K50.9(DOUT)
$1N13840: K50.11(DIN) K51.9(DOUT)
$1N13844: K51.11(DIN) K52.9(DOUT)
$1N13848: K52.11(DIN) K53.9(DOUT)
$1N13852: K53.11(DIN) K54.9(DOUT)
$1N13856: K54.11(DIN) K55.9(DOUT)
$1N13904: K61.11(DIN) K62.9(DOUT)
$1N13908: K60.11(DIN) K61.9(DOUT)
$1N13916: K59.11(DIN) K60.9(DOUT)
$1N13920: K58.11(DIN) K59.9(DOUT)
$1N13924: K57.11(DIN) K58.9(DOUT)
$1N13928: K56.11(DIN) K57.9(DOUT)
$1N13932: K55.11(DIN) K56.9(DOUT)
$1N13936: K77.11(DIN) K78.9(DOUT)
$1N13940: K76.11(DIN) K77.9(DOUT)
$1N13944: K75.11(DIN) K76.9(DOUT)
$1N13948: K74.11(DIN) K75.9(DOUT)
$1N13952: K73.11(DIN) K74.9(DOUT)
$1N13956: K72.11(DIN) K73.9(DOUT)
$1N13960: K71.11(DIN) K72.9(DOUT)
$1N13964: K70.11(DIN) K71.9(DOUT)
$1N13968: K69.11(DIN) K70.9(DOUT)
$1N13972: K68.11(DIN) K69.9(DOUT)
$1N13976: K65.11(DIN) K66.9(DOUT)
$1N13980: K66.11(DIN) K67.9(DOUT)
$1N13984: K67.11(DIN) K68.9(DOUT)
$1N13988: K81.11(DIN) K82.9(DOUT)
$1N13992: K82.11(DIN) K83.9(DOUT)
$1N13996: K83.11(DIN) K84.9(DOUT)
$1N14000: K84.11(DIN) K85.9(DOUT)
$1N14004: K85.11(DIN) K86.9(DOUT)
$1N14008: K94.11(DIN) K95.9(DOUT)
$1N14012: K95.11(DIN) K96.9(DOUT)
$1N14016: K91.11(DIN) K94.9(DOUT)
$1N14021: K86.11(DIN) K91.9(DOUT)
$1N18227: D19.1(A) K31.1
$1N18268: D20.1(A) K47.2
$1N22738: D47.1(A) K91.1
$1N22742: D48.1(A) K94.1
$1N23136: D3.2 K15.1
$1N23140: D3.1 K16.2
$1N23145: D4.2 K13.1
$1N23152: D4.1 K14.2
$1N23170: D5.2 K11.1
$1N23177: D5.1 K12.2
$1N23187: D7.2 K9.1
$1N23195: D7.1 K10.2
$1N23205: D8.2 K7.1
$1N23215: D8.1 K8.2
$1N23225: D9.2 K5.1
$1N23232: D9.1 K6.2
$1N23242: D10.2 K3.1
$1N23249: D10.1 K4.2
$1N23259: D11.2 K1.1
$1N23269: D11.1 K2.2
$1N23286: D18.2 K29.1
$1N23293: D18.1 K30.2
$1N23298: D17.1 K28.2
$1N23303: D17.2 K27.1
$1N23310: D16.2 K25.1
$1N23317: D16.1 K26.2
$1N23327: D15.2 K23.1
$1N23334: D15.1 K24.2
$1N23344: D14.2 K21.1
$1N23351: D14.1 K22.2
$1N23356: D13.2 K19.1
$1N23363: D13.1 K20.2
$1N23466: D12.2 K17.1
$1N23473: D12.1 K18.2
$1N23478: D21.2 K45.1
$1N23485: D21.1 K46.2
$1N23490: D22.2 K43.1
$1N23497: D22.1 K44.2
$1N23502: D23.2 K41.1
$1N23509: D23.1 K42.2
$1N23514: D24.2 K39.1
$1N23521: D24.1 K40.2
$1N23531: D25.2 K37.1
$1N23540: D25.1 K38.2
$1N23550: D26.2 K35.1
$1N23560: D26.1 K36.2
$1N23565: D28.2 K33.1
$1N23572: D28.1 K34.2
$1N23582: D29.1 K50.2
$1N23587: D29.2 K49.1
$1N23594: D30.2 K51.1
$1N23601: D30.1 K52.2
$1N23611: D31.2 K53.1
$1N23618: D31.1 K54.2
$1N23623: D32.2 K55.1
$1N23630: D32.1 K56.2
$1N23640: D33.2 K57.1
$1N23653: D33.1 K58.2
$1N23662: D34.2 K59.1
$1N23681: D34.1 K60.2
$1N23689: D36.2 K61.1
$1N23696: D36.1 K62.2
$1N23701: D43.2 K77.1
$1N23708: D43.1 K78.2
$1N23718: D42.2 K75.1
$1N23725: D42.1 K76.2
$1N23730: D41.2 K73.1
$1N23737: D41.1 K74.2
$1N23747: D40.2 K71.1
$1N23758: D40.1 K72.2
$1N23763: D39.2 K69.1
$1N23770: D39.1 K70.2
$1N23775: D38.2 K67.1
$1N23782: D38.1 K68.2
$1N23787: D37.2 K65.1
$1N23794: D37.1 K66.2
$1N23799: D44.2 K81.1
$1N23806: D44.1 K82.2
$1N23816: D45.2 K83.1
$1N23823: D45.1 K84.2
$1N23833: D46.2 K85.1
$1N23840: D46.1 K86.2
$1N23850: D49.2 K95.1
$1N23857: D49.1 K96.2
$2N558: C1.2 U1.1(DEC1)
$2N766: R1.1 R3.2 U1.26(SWDIO)
$2N778: R2.1 R4.1 U1.25(SWDCLK)
$2N1058: C4.1 U1.33(DEC3)
$2N1070: C3.1 U1.32(DEC2)
$2N1199: U1.34(XC1) X1.1(OSC1)
$2N1205: U1.35(XC2) X1.3(OSC2)
$2N1424: C6.1 U1.44(MIC_LDO)
$2N1593: L1.1 U1.47(DCC)
$2N1696: C7.1 L1.2 U1.46(DEC4)
$2N2387: C9.2 R5.2 R7.1
$2N2497: C10.2 R7.2 RF1.1(SIG)
$2N2602: C12.2 R6.1 R8.2
$2N2641: ANT1.1(SIGNAL) C11.2 R8.1
$2N4369: R9.2 R11.1
$2N4395: R10.2 R12.1
$2N4783: R13.2 U3.2(PROG)
$2N8971: C21.2 Q1.1(G) R21.1 SW2.1 SW2.2 U5.4(EN)
$2N9152: Q1.3(D) R22.2
$2N9229: R23.2 U5.3(SET)
$2N10910: D51.2(K) Q2.2(S) SW3.3
$2N23447: L5.1 U6.3(SW)
$2N23725: R24.2 R25.1 U6.5(FB)

Not connected (* = marked no-connect by the designer): CN2 1*; K1 9(DOUT)*; K17 9(DOUT)*; K33 9(DOUT)*; K49 9(DOUT)*; K65 9(DOUT)*; K81 9(DOUT)*; SW3 6
